# EasyEDA Pro project 效果器12-18.eprj, schematic Schematic1 (continued)
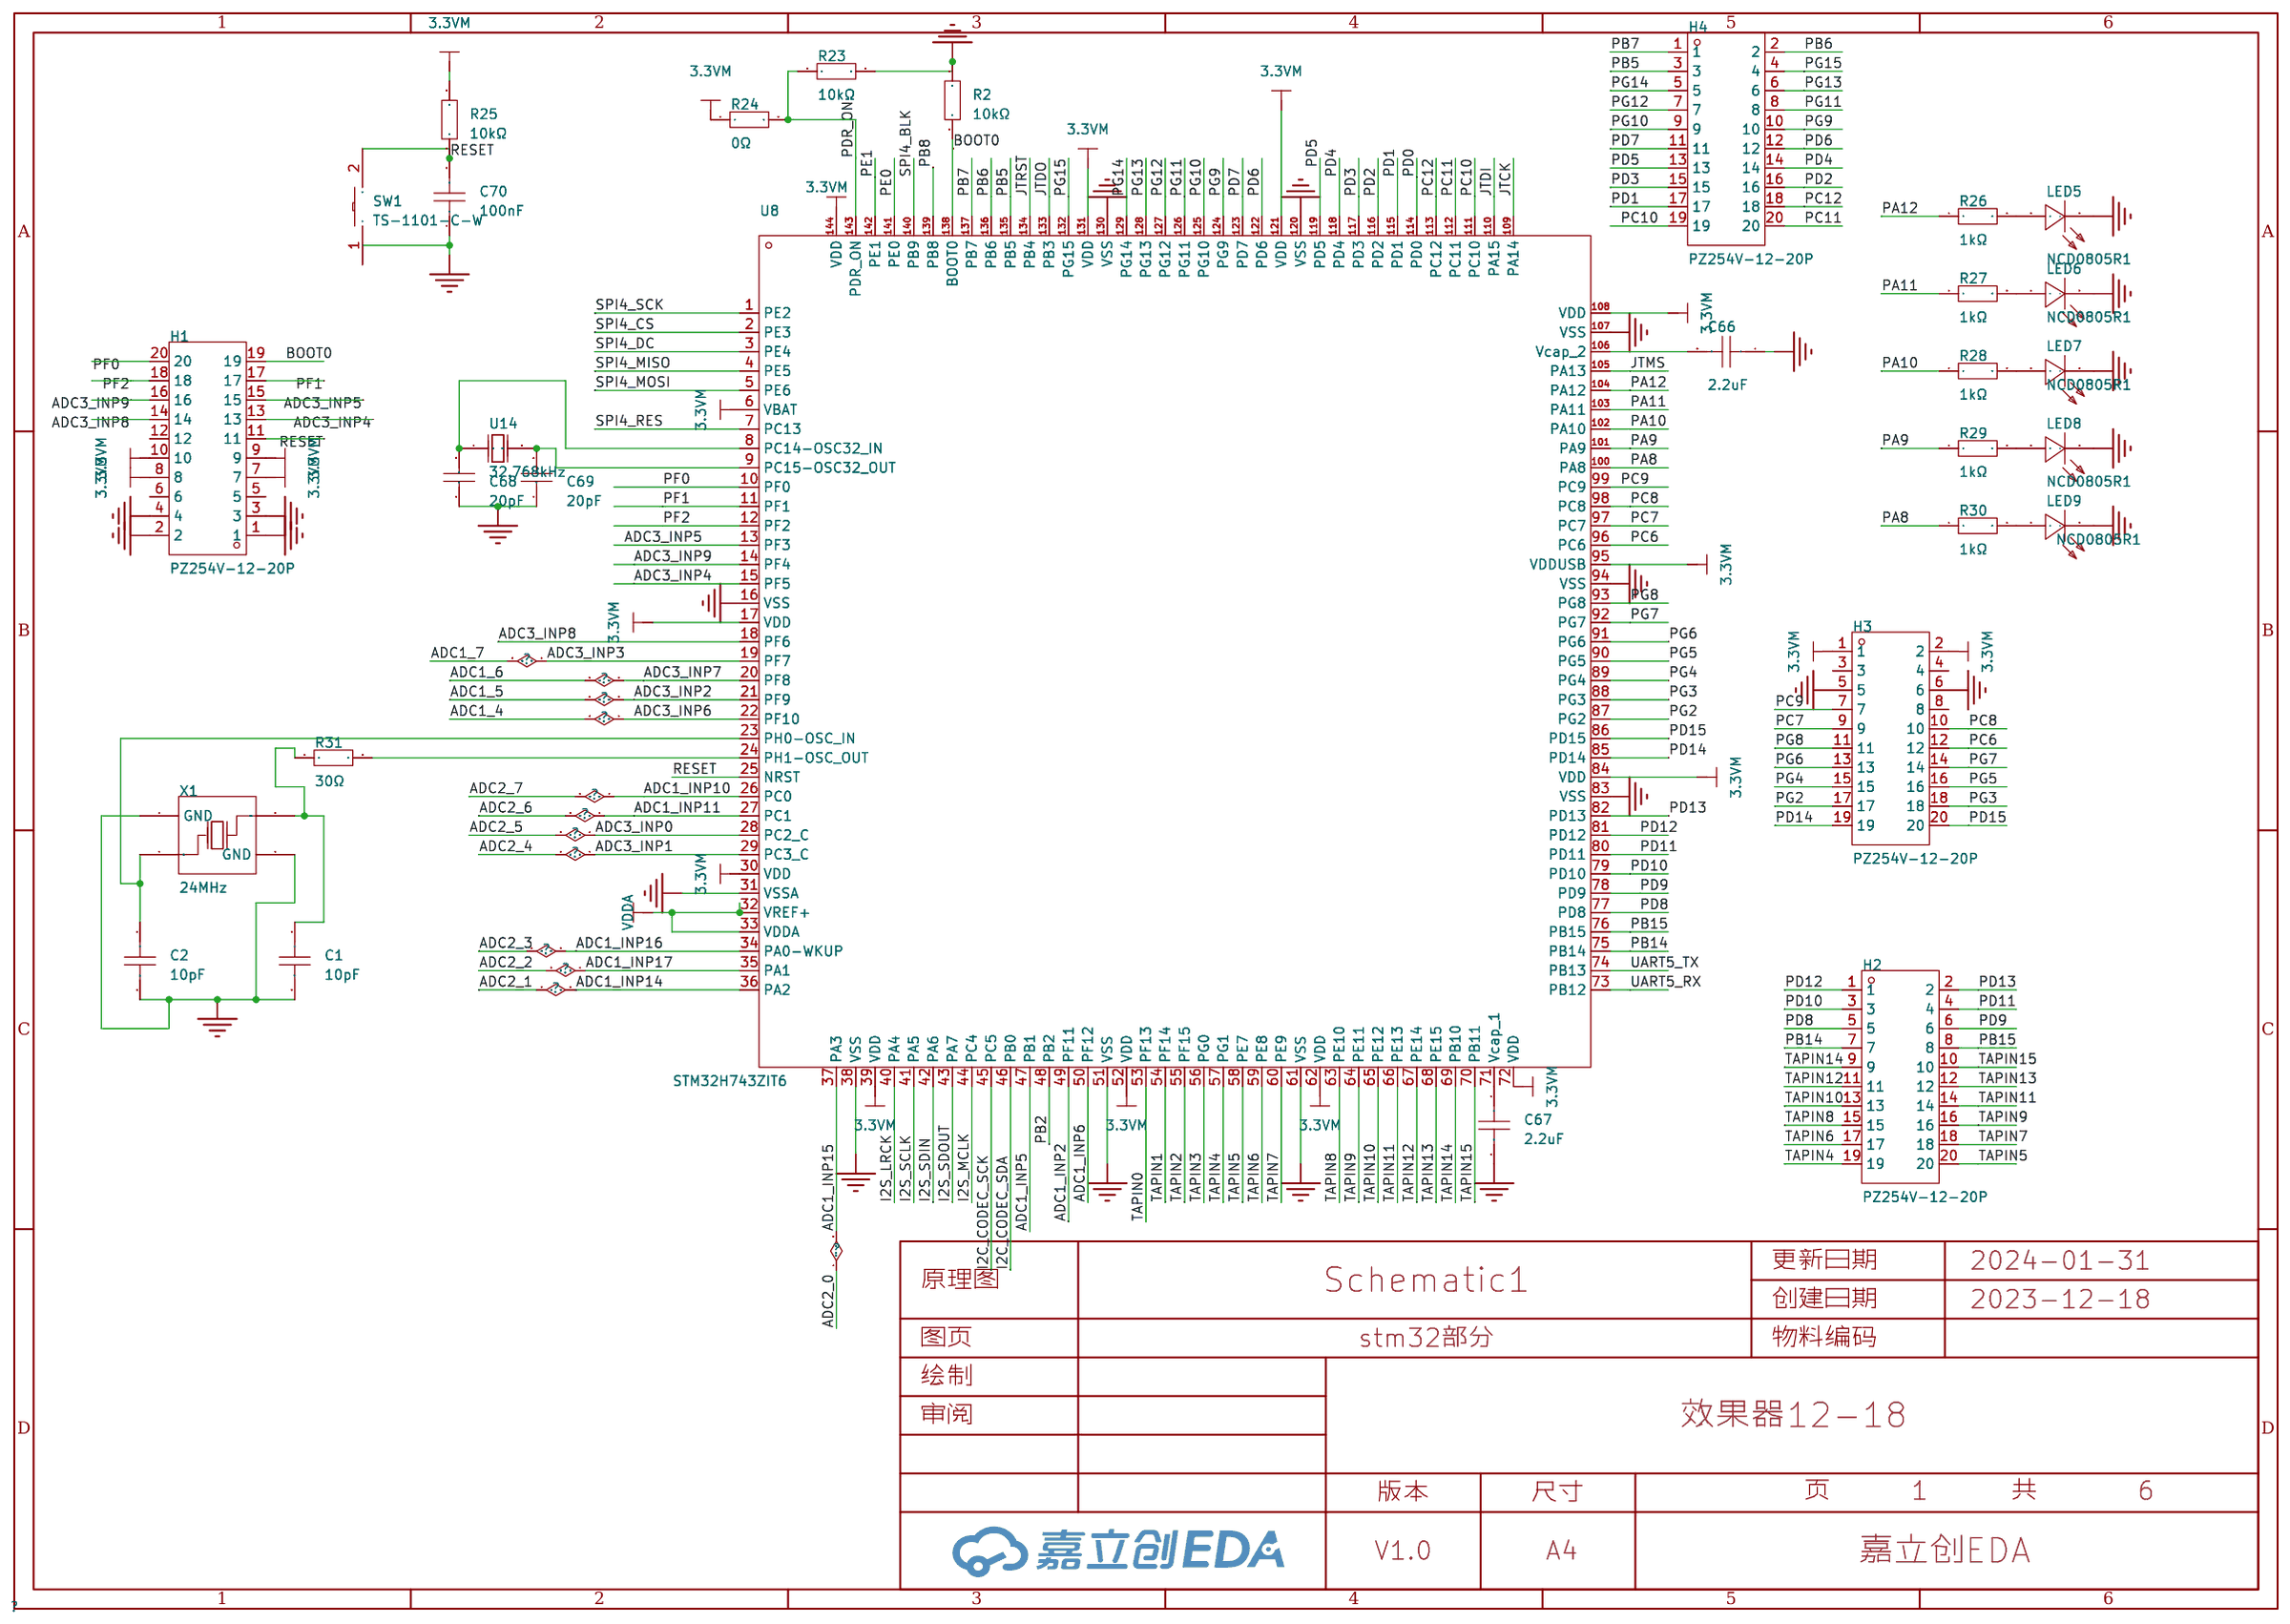
[diagram p0: stm32部分]
## Library data of the parts (continued)
LED5-LED9 = NCD0805R1: 发光颜色:红色;二极管配置:-;功率:65mW;透镜颜色:无色透明;主波长:615nm~630nm;色温:-;发光强度:67mcd~195mcd;发光角度:130°;安装方式:-;工作温度:-30℃~+85℃;; LCSC Part Name: 红灯 0805红灯   正贴; Supplier Part: C84256; Manufacturer: 国星光电; Supplier Footprint: 0805; JLCPCB Part Class: Basic Part; Datasheet: https://atta.szlcsc.com/upload/public/pdf/source/20200820/C84256_F0A75A43B3EAD75808600A0514C76B99.pdf; Supplier: LCSC; Emitted Color: 红色; Forward Voltage (VF): 1.6V~2.6V; Forward Current: 20mA; Power Dissipation: 65mW; Lens Color: 无色透明; Dominant Wavelength: 615nm~630nm; Luminous Intensity: 67mcd~195mcd; Viewing Angle: 130°; Operating Temperature: -30℃~+85℃; Check: true
R2 R8 R10-R14 R23 R25 R33 = 0603WAF1002T5E: 阻值:10kΩ;精度:±1%;功率:100mW;温度系数:±100ppm/℃;电阻类型:厚膜电阻;; LCSC Part Name: 10kΩ ±1% 100mW 厚膜电阻; Supplier Part: C25804; Manufacturer: UNI-ROYAL(厚声); Supplier Footprint: 0603; JLCPCB Part Class: Basic Part; Datasheet: https://atta.szlcsc.com/upload/public/pdf/source/20200306/C422600_1E6D84923E4A46A82E41ADD87F860B5C.pdf; Supplier: LCSC; Tolerance: ±1%; Power(Watts): 100mW; Overload Voltage (Max): 75V; Temperature Coefficient: ±100ppm/℃; Type: 厚膜电阻; Operating Temperature Range: -55℃~+155℃; Check: true
R6 R24 = 0805W8F0000T5E: 阻值:0Ω;精度:±1%;功率:125mW;温度系数:±800ppm/℃;电阻类型:厚膜电阻;; LCSC Part Name: 0Ω ±1% 125mW 厚膜电阻; Supplier Part: C17477; Manufacturer: UNI-ROYAL(厚声); Supplier Footprint: 0805; JLCPCB Part Class: 基础库; Datasheet: https://atta.szlcsc.com/upload/public/pdf/source/20200306/C422600_1E6D84923E4A46A82E41ADD87F860B5C.pdf; Supplier: LCSC; Tolerance: ±1%; Power(Watts): 125mW; Overload Voltage (Max): 150V; Temperature Coefficient: ±800ppm/℃; Type: 厚膜电阻; Operating Temperature Range: -55℃~+155℃; Check: true
R26-R30 R32 R34 R35 = 0603WAF1001T5E: 阻值:1kΩ;精度:±1%;功率:100mW;温度系数:±100ppm/℃;电阻类型:厚膜电阻;; LCSC Part Name: 1kΩ ±1% 100mW 厚膜电阻; Supplier Part: C21190; Manufacturer: UNI-ROYAL(厚声); Supplier Footprint: 0603; JLCPCB Part Class: Basic Part; Datasheet: https://atta.szlcsc.com/upload/public/pdf/source/20200306/C422600_1E6D84923E4A46A82E41ADD87F860B5C.pdf; Supplier: LCSC; Tolerance: ±1%; Power(Watts): 100mW; Overload Voltage (Max): 75V; Temperature Coefficient: ±100ppm/℃; Type: 厚膜电阻; Operating Temperature Range: -55℃~+155℃; Check: true
R31 = RC0402FR-0730RL: 电阻类型:厚膜电阻;阻值:30Ω;精度:±1%;功率:62.5mW;; LCSC Part Name: 30Ω ±1% 62.5mW; Supplier Part: C138007; Manufacturer: YAGEO(国巨); Supplier Footprint: 0402; JLCPCB Part Class: Extended Part; Datasheet: https://atta.szlcsc.com/upload/public/pdf/source/20171107/C138007_15100516349381096934.pdf; Supplier: LCSC; Type: 厚膜电阻; Tolerance: ±1%; Power(Watts): 62.5mW; Temperature Coefficient: ±100ppm/℃; Overload Voltage (Max): 50V; Operating Temperature Range: -55℃~+155℃; Check: true
SW1 = TS-1101-C-W: 电路结构:单刀单掷;带支架:否;触点电流:50mA;额定电压(AC):-;额定电压(DC):12V;额定功率:-;安装方式:立贴;绝缘电阻:-;带灯:无;作用力:260gf;机械寿命:5万次;; LCSC Part Name: 6*3.6*2.5mm 立贴 轻触开关 白色带淡绿按键 卷装; Supplier Part: C318938; Manufacturer: XKB Connectivity(中国星坤); Supplier Footprint: SMD; JLCPCB Part Class: 扩展库; Datasheet: https://atta.szlcsc.com/upload/public/pdf/source/20200227/C318938_C2E53B1EEDE37D980A33616AC086DE53.pdf; Supplier: LCSC; Circuit: 单刀单掷; Actuator Style: 矩形按钮; Switch Length: 6mm; Switch Width: 3.6mm; Switch Height: 2.5mm; Strike Gundam: 否; Contact Current: 50mA; Voltage Rating (DC): 12V; Mounting Style: 立贴; Actuator/Cap Color: 白色带淡绿; With Lamp: 无; Operating Force: 260gf; Mechanical Life: 5万次; Operating Temperature: -30℃~+85℃; Check: true
U8 = STM32H743ZIT6: CPU内核:ARM-M系列;CPU最大主频:480MHz;程序存储容量:2MB;程序存储器类型:FLASH;RAM总容量:1MB;GPIO端口数量:114;; LCSC Part Name: ARM-M系列 480MHz; Supplier Part: C114408; Manufacturer: ST(意法半导体); Supplier Footprint: LQFP-144(20x20); JLCPCB Part Class: 扩展库; Datasheet: https://atta.szlcsc.com/upload/public/pdf/source/20171116/C114408_15108221021511123673.pdf; Supplier: LCSC; CPU Core: ARM-M系列; CPU Maximum Speed: 480MHz; Operating Voltage Range: 1.62V~3.6V; Program Storage Size: 2MB; Program Memory Type: FLASH; RAM Size: 1MB; GPIO Ports Number: 114; ADC (Bit): 16bit; DAC (Bit): 12bit; Universal Serial Bus: 有; Peripheral/Function: DMA；LCD/LED驱动; Watchdog: 有; Infrared Data Association: 有; Low-Voltage Detect: 有; LCD Module: 有; Secure Digital Input and Output: 有; Direct Memory Access: 有; Internal Oscillator: 有; Operating Temperature Range: -40℃~+85℃; Check: true
U14 = RN32768B40: 频率:32.768kHz;负载电容:12.5pF;频率公差:±20ppm;; LCSC Part Name: 32.768kHz ±20ppm 12.5pF; Supplier Part: C7206318; Manufacturer: TROQ(创捷); Supplier Footprint: TuningFork2012; Datasheet: https://atta.szlcsc.com/upload/public/pdf/source/20230606/1A6BC7ABFCE214E301EFD0E0D97E50F7.pdf; Supplier: LCSC; Load Capacitance: 12.5pF; Equivalent Series Resistance (ESR): 70Ω; Frequency Tolerance: ±20ppm; Operating Temperature: -40℃~+85℃; Check: true
X1 = X1E000021012700: 频率:24MHz;负载电容:9pF;频率公差:±10ppm;; LCSC Part Name: 24MHz ±10ppm 9pF; Supplier Part: C89577; Manufacturer: EPSON(爱普生); Supplier Footprint: SMD3225-4P; JLCPCB Part Class: Extended Part; Datasheet: https://atta.szlcsc.com/upload/public/pdf/source/20161130/1480474612820.pdf; Supplier: LCSC; Crystal Type: 贴片无源晶振; Load Capacitance: 9pF; Equivalent Series Resistance (ESR): 40Ω; Frequency Tolerance: ±10ppm; Operating Temperature: -40℃~+85℃; Check: true
D4 = 1N4148WS_C2128: 二极管配置:独立式;正向压降(Vf):1.25V@150mA;直流反向耐压(Vr):100V;平均整流电流(Io):150mA;功率:200mW;反向恢复时间(trr):4ns;; LCSC Part Name: 电压:100V 电流:150mA; Supplier Part: C2128; Manufacturer: CJ(江苏长电/长晶); Supplier Footprint: SOD-323; JLCPCB Part Class: 基础库; Datasheet: https://atta.szlcsc.com/upload/public/pdf/source/20140809/1457707208178.pdf; Supplier: LCSC; Diode Configuration: 独立式; Forward Voltage (Vf@If): 1.25V@150mA; Reverse Voltage (Vr): 100V; Average Rectified Current (Io): 150mA; Power Dissipation: 200mW; Reverse Leakage Current: 1uA@75V; Reverse Recovery Time (trr): 4ns
JTAG1 = BH254V-20P: 连接器类型:简牛座;每排PIN数:10;结构:2x10P;排数:2;间距:2.54mm;行距:2.54mm;封装形式:直插;额定电流:3A;额定电压:250V;工作温度范围:-40℃~+105℃;; LCSC Part Name: 每排P数:10 2x10P 排数:2 2.54mm; Supplier Part: C492444; Manufacturer: XFCN(兴飞); Supplier Footprint: 插件,P=2.54mm; JLCPCB Part Class: Extended Part; Datasheet: https://atta.szlcsc.com/upload/public/pdf/source/20200312/C492444_4AABE2FC4F6BE8226B85135616AF0092.pdf; Supplier: LCSC; Connector Type: 简牛座; Pin Number in each Row: 10; Structure: 2x10P; Number of Rows: 2; Pitch: 2.54mm; Row Spacing: 2.54mm; Holder Type: 直插; Current Rating (Max): 3A; Voltage Rating (Max): 250V; Operating Temperature Range: -40℃~+105℃; Check: true
Q1 = S8050_C2891804: 晶体管类型:NPN;集电极电流(Ic):500mA;集射极击穿电压(Vceo):25V;功率(Pd):300mW;; LCSC Part Name: NPN 电流:500mA 耐压:25V; Supplier Part: C2891804; Manufacturer: YONGYUTAI(永裕泰); Supplier Footprint: SOT-23; JLCPCB Part Class: 扩展库; Datasheet: https://atta.szlcsc.com/upload/public/pdf/source/20210901/5347316A10609C628D4D69AE01446E5B.pdf; Supplier: LCSC; Transistor Type: NPN; Collector Current (Ic): 500mA; Collector-Emitter Breakdown Voltage (Vceo): 25V; Power Dissipation (Pd): 300mW; Collector Cut-Off Current (Icbo): 1uA; Collector-Emitter Saturation Voltage (VCE(sat)@Ic,Ib): 500mV@500mA,50mA
Q2 = S8550_C727136: 晶体管类型:PNP;集电极电流(Ic):500mA;集射极击穿电压(Vceo):25V;功率(Pd):300mW;直流电流增益(hFE@Ic,Vce):200@50mA,1V;; LCSC Part Name: PNP 电流:500mA 耐压:25V; Supplier Part: C727136; Manufacturer: TWGMC(台湾迪嘉); Supplier Footprint: SOT-23; JLCPCB Part Class: 扩展库; Datasheet: https://atta.szlcsc.com/upload/public/pdf/source/20200827/C727136_B498F8FD567BF05363CA70C4EF1CFE98.pdf; Supplier: LCSC; Transistor Type: PNP; Collector Current (Ic): 500mA; Collector-Emitter Breakdown Voltage (Vceo): 25V; Power Dissipation (Pd): 300mW; DC Current Gain (hFE@Ic,Vce): 200@50mA,1V; Transition Frequency (fT): 150MHz; Collector Cut-Off Current (Icbo): 100nA; Collector-Emitter Saturation Voltage (VCE(sat)@Ic,Ib): 600mV@500mA,50mA
SPI_SCREEN = XH-8A: 插针结构:1x8P;间距:2.5mm;安装方式:直插;行距:-;总PIN数:8P;排数:1;每排PIN数:8;参考系列:XH;额定电流:3A;工作温度范围:-25℃~+85℃;; LCSC Part Name: 1x8P 间距:2.5mm 直插 系列:XH; Supplier Part: C2908606; Manufacturer: HCTL(华灿天禄); Supplier Footprint: 插件,P=2.5mm; JLCPCB Part Class: Extended Part; Datasheet: https://atta.szlcsc.com/upload/public/pdf/source/20230711/68D365716984B4AFE576D1D73D61B465.pdf; Supplier: LCSC; Pins Structure: 1x8P; Pitch: 2.5mm; Mounting Style: 直插; Number of Pins: 8P; Number of Rows: 1; Number of PINs Per Row: 8; Reference Series: XH; Current Rating (Max): 3A; Operating Temperature Range: -25℃~+85℃; Check: true
U20 = CH340C: 应用功能:收发器;接口协议:USB 2.0;数据速率:2Mbps;; LCSC Part Name: CH340C USB转串口芯片 CH340; Supplier Part: C84681; Manufacturer: WCH(南京沁恒); Supplier Footprint: SOP-16; JLCPCB Part Class: 扩展库; Datasheet: https://atta.szlcsc.com/upload/public/pdf/source/20200819/C84681_ADBED554CE321879DBD6B1D06488689C.pdf; Supplier: LCSC; Applications Function: 收发器; Protocol: USB 2.0; Data Rate: 2Mbps; Supply Voltage: 3.3V；5V
USB1 = UX-144S-ACP5: 连接器类型:Mini-B;标准:USB 2.0;公母:母;触点数量:5P;端口数量:1;安装方式:卧贴;额定电流 - 电源:1.5A;工作温度范围:-20℃~+70℃;焊接温度(最大值):260℃;; LCSC Part Name: Mini-B 母 卧贴; Supplier Part: C720611; Manufacturer: XUNPU(讯普); Supplier Footprint: SMD; JLCPCB Part Class: Extended Part; Datasheet: https://atta.szlcsc.com/upload/public/pdf/source/20200812/C720611_E8490E4C4B00597353DD684194E98629.pdf; Supplier: LCSC; Connector Type: Mini-B; Standard: USB 2.0; Gender: 母; Number of Contacts: 5P; Number of Ports: 1; Mounting Style: 卧贴; Current Rating - Power (Max): 1.5A; Operating Temperature Range: -20℃~+70℃; Welding Temperature (Max): 260℃; Check: true
C3 = CL10B104KB8NNNC: 容值:100nF;精度:±10%;额定电压:50V;材质(温度系数):X7R;; LCSC Part Name: 100nF ±10% 50V; Supplier Part: C1591; Manufacturer: SAMSUNG(三星); Supplier Footprint: 0603; JLCPCB Part Class: Extended Part; Datasheet: https://atta.szlcsc.com/upload/public/pdf/source/20160218/1457707763339.pdf; Supplier: LCSC; Tolerance: ±10%; Voltage Rated: 50V; Temperature Coefficient: X7R; Check: true
C4 = CL21A106KAYNNNE_C15850: 容值:10uF;精度:±10%;额定电压:25V;材质(温度系数):X5R;; LCSC Part Name: 10uF ±10% 25V; Supplier Part: C15850; Manufacturer: SAMSUNG(三星); Manufacturer Part: CL21A106KAYNNNE; Supplier Footprint: 0805; JLCPCB Part Class: Basic Part; Datasheet: https://atta.szlcsc.com/upload/public/pdf/source/20160103/1457707679302.pdf; Supplier: LCSC; Tolerance: ±10%; Voltage Rated: 25V; Temperature Coefficient: X5R; Power(Watts): 100mW; Overload Voltage (Max): 75V; Type: 厚膜电阻; Operating Temperature Range: -55℃~+155℃; Check: true
C5 = 0805B103K500NT_C52278: 容值:10nF;精度:±10%;额定电压:50V;材质(温度系数):X7R;; LCSC Part Name: 10nF ±10% 50V; Supplier Part: C52278; Manufacturer: FH(风华); Manufacturer Part: 0805B103K500NT; Supplier Footprint: 0805; JLCPCB Part Class: 扩展库; Datasheet: https://atta.szlcsc.com/upload/public/pdf/source/20200305/C486355_26A10D38EF8C2A5C37091D0039909270.pdf; Supplier: LCSC; Tolerance: ±10%; Voltage Rated: 50V; Temperature Coefficient: X7R; Check: true
C7 C10 C13 C31 C32 C48 = RST100UF16V003: 容值:100uF;精度:±20%;额定电压:16V;纹波电流:60mA@120Hz;等效串联电阻:-;; LCSC Part Name: 100uF ±20% 16V; Supplier Part: C4747963; Manufacturer: KNSCHA(科尼盛); Supplier Footprint: SMD,D6.3xL5.4mm; JLCPCB Part Class: Extended Part; Datasheet: https://atta.szlcsc.com/upload/public/pdf/source/20220722/9429C795432790648606E5D5964068FF.pdf; Supplier: LCSC; Tolerance: ±20%; Rated Voltage: 16V; Ripple Current: 60mA@120Hz; φD: 6.3mm; L: 5.4mm; Lifetime @ Temp: 2000hrs@105℃; Operating Temperature: -55℃~+105℃; Check: true
D1-D3 = SS24_C50645: 正向压降(Vf):550mV@2A;直流反向耐压(Vr):40V;平均整流电流(Io):2A;; LCSC Part Name: 电压:40V 电流:2A; Supplier Part: C50645; Manufacturer: MDD; Supplier Footprint: SMA(DO-214AC); JLCPCB Part Class: Extended Part; Datasheet: https://atta.szlcsc.com/upload/public/pdf/source/20230314/0DB686FE9AB7A29C3C9F91DCAAB84FDC.pdf; Supplier: LCSC; Forward Voltage (Vf@If): 550mV@2A; Reverse Voltage (Vr): 40V; Average Rectified Current (Io): 2A; Check: true
DC1 = DC-005-A250: 连接器类型:DC电源插座;安装方式:弯插;触点内径:2.5mm;触点外径:6.3mm;额定电流:3A;额定电压:30V;工作温度范围:-20℃~+70℃;; LCSC Part Name: DC电源插座 内径:2.5mm 外径:6.3mm; Supplier Part: C720558; Manufacturer: XUNPU(讯普); Supplier Footprint: 插件; JLCPCB Part Class: Extended Part; Datasheet: https://atta.szlcsc.com/upload/public/pdf/source/20220428/F133011953B124341225656709BD6AA6.pdf; Supplier: LCSC; Connector Type: DC电源插座; Mounting Style: 弯插; Inside Contact Diameter: 2.5mm; Outside Contact Diameter: 6.3mm; Current Rating (Max): 3A; Voltage Rating (Max): 30V; Operating Temperature Range: -20℃~+70℃; Check: true
F1 F2 = BSMD1206-100-16V: 最大电压:16V;最大电流:100A;保持电流:1A;跳闸电流:1.8A;; LCSC Part Name: 16V 1A 1206自恢复; Supplier Part: C883131; Manufacturer: BHFUSE(佰宏); Supplier Footprint: 1206; JLCPCB Part Class: Extended Part; Datasheet: https://atta.szlcsc.com/upload/public/pdf/source/20230512/E419278EC8529AAF514173EF221BCF4B.pdf; Supplier: LCSC; Operating Voltage (Max): 16V; Current Rating (Max): 100A; Hold Current: 1A; Trip Current: 1.8A; Power Dissipation: 800mW; Resistance - Initial (Ri) (Min): 50mΩ; Resistance - Post Trip (R1) (Max): 270mΩ; Maximum Time to Trip: 300ms; Operating Temperature: -40℃~+85℃; Check: true
L1 = SM3521-4R7MT: 电感值:4.7uH;精度:±20%;额定电流:1A;饱和电流(Isat):1.6A;; LCSC Part Name: 4.7uH ±20% 1.6A; Supplier Part: C35602; Manufacturer: SXN(顺翔诺); Supplier Footprint: SMD; JLCPCB Part Class: Extended Part; Datasheet: https://atta.szlcsc.com/upload/public/pdf/source/20210810/DE909F839CF261ABDAA312DFDF4FA1A6.pdf; Supplier: LCSC; Tolerance: ±20%; Rated Current: 1A; Saturation Current (Isat): 1.6A; DC Resistance (DCR): 135mΩ; Check: true
L2 = PZ1608D121-2R0TF: 标称阻抗@测试频率:120Ω@100MHz;误差:±25%;直流电阻(RDC):-;; LCSC Part Name: 单路 0603磁珠 阻抗120Ω@100MHz; Supplier Part: C42102; Manufacturer: Sunlord(顺络); Supplier Footprint: 0603; JLCPCB Part Class: Extended Part; Datasheet: https://atta.szlcsc.com/upload/public/pdf/source/20210816/2FE48A83668C9496AD98DE44B7F0FA96.pdf; Supplier: LCSC; Impedance @ Frequency: 120Ω@100MHz; Tolerance: ±25%; Current Rating: 2A; Circuits: 1; Check: true
LED1-LED4 = TJ-S1005SW4TGLC9Y-A5: 发光颜色:黄灯;; LCSC Part Name: 黄灯; Supplier Part: C273600; Manufacturer: TOGIALED(统佳); Supplier Footprint: 0402; JLCPCB Part Class: 扩展库; Datasheet: https://atta.szlcsc.com/upload/public/pdf/source/20180904/C273600_90EE9CCDA7679C2DC32A5FA503DEF3E6.pdf; Supplier: LCSC; Emitted Color: 黄灯; Check: true
R3 R5 = CR0805F12K1P05Z: 电阻类型:厚膜电阻;阻值:12.1kΩ;精度:±1%;功率:125mW;; LCSC Part Name: 12.1kΩ ±1% 125mW; Supplier Part: C245232; Manufacturer: EVER OHMS(天二科技); Supplier Footprint: 0805; JLCPCB Part Class: Extended Part; Datasheet: https://atta.szlcsc.com/upload/public/pdf/source/20190516/C245232_35C0C5B85EEB2B9019CCEC90E854E655.pdf; Supplier: LCSC; Type: 厚膜电阻; Tolerance: ±1%; Power(Watts): 125mW; Temperature Coefficient: ±100ppm/℃; Overload Voltage (Max): 150V; Operating Temperature Range: -55℃~+155℃; Check: true
R4 = 0805W8F6802T5E: 阻值:68kΩ;精度:±1%;功率:125mW;温度系数:±100ppm/℃;电阻类型:厚膜电阻;; LCSC Part Name: 68kΩ ±1% 125mW 厚膜电阻; Supplier Part: C17801; Manufacturer: UNI-ROYAL(厚声); Supplier Footprint: 0805; JLCPCB Part Class: Basic Part; Datasheet: https://atta.szlcsc.com/upload/public/pdf/source/20200306/C422600_1E6D84923E4A46A82E41ADD87F860B5C.pdf; Supplier: LCSC; Tolerance: ±1%; Power(Watts): 125mW; Overload Voltage (Max): 150V; Temperature Coefficient: ±100ppm/℃; Type: 厚膜电阻; Operating Temperature Range: -55℃~+155℃; Check: true
U2 = TPMP2359DJ: Supplier Part: C2959845; Manufacturer: TECH PUBLIC(台舟); Supplier Footprint: SOT-23-6; JLCPCB Part Class: 扩展库; Datasheet: https://atta.szlcsc.com/upload/public/pdf/source/20220124/136D7E5097025173C84A8EB547201C3F.pdf; Supplier: LCSC; Check: true
U3 U5 U11 = LM1117S-3.3: 输出类型:固定;输出极性:正;最大输入电压:12V;输出电压:3.3V;输出电流:1A;电源纹波抑制比(PSRR):75dB@(120Hz);; LCSC Part Name: 输入12V 输出3.3V 1A; Supplier Part: C126027; Manufacturer: HTC; Supplier Footprint: SOT-223; JLCPCB Part Class: 扩展库; Datasheet: https://atta.szlcsc.com/upload/public/pdf/source/20170814/C126027_1502678373551885899.pdf; Supplier: LCSC; Output Type: 固定; Output Polarity: 正; Number of Outputs: 1; Maximum Input Voltage: 12V; Output Voltage: 3.3V; Dropout Voltage: 1.3V@(1A); Output Current: 1A; Power Supply Rejection Ratio (PSRR): 75dB@(120Hz); Check: true
C28 C30 C33 C35 = CL10A106MP8NNNC: 容值:10uF;精度:±20%;额定电压:10V;材质(温度系数):X5R;; LCSC Part Name: 10uF ±20% 10V; Supplier Part: C85713; Manufacturer: SAMSUNG(三星); Supplier Footprint: 0603; JLCPCB Part Class: Extended Part; Datasheet: https://atta.szlcsc.com/upload/public/pdf/source/20160218/1457707763339.pdf; Supplier: LCSC; Tolerance: ±20%; Voltage Rated: 10V; Temperature Coefficient: X5R; Check: true
C37 C38 C75 C76 = CL05A105KP5NNNC: 容值:1uF;精度:±10%;额定电压:10V;材质(温度系数):X5R;; LCSC Part Name: 1uF ±10% 10V; Supplier Part: C14445; Manufacturer: SAMSUNG(三星); Supplier Footprint: 0402; JLCPCB Part Class: Extended Part; Datasheet: https://atta.szlcsc.com/upload/public/pdf/source/20160218/1457707763339.pdf; Supplier: LCSC; Tolerance: ±10%; Voltage Rated: 10V; Temperature Coefficient: X5R; Check: true
CN1 = PJ-313D_C668608: 连接器类型:3.5mm耳机座;额定电流:500mA;额定电压:30V;工作温度范围:-30℃~+70℃;; LCSC Part Name: 3.5mm耳机座; Supplier Part: C668608; Manufacturer: SHOU HAN(首韩); Supplier Footprint: SMD; JLCPCB Part Class: Extended Part; Datasheet: https://atta.szlcsc.com/upload/public/pdf/source/20200618/C668608_AB2020DBBA26E8897834D328F2FA3C40.pdf; Supplier: LCSC; Connector Type: 3.5mm耳机座; Current Rating (Max): 500mA; Voltage Rating (Max): 30V; Operating Temperature Range: -30℃~+70℃; Check: true
LINEIN1 LINEOUT1 = ZX-XH2.54-3PZZ: 插针结构:1x3P;间距:2.54mm;安装方式:直插;行距:-;总PIN数:3P;排数:1;每排PIN数:3;参考系列:XH;额定电流:3A;触头材质:黄铜;触头镀层:锡;工作温度范围:-25℃~+85℃;; LCSC Part Name: 1x3P 间距:2.54mm 直插 系列:XH; Supplier Part: C7429633; Manufacturer: Megastar(兆星); Supplier Footprint: 插件,P=2.54mm; JLCPCB Part Class: Extended Part; Datasheet: https://atta.szlcsc.com/upload/public/pdf/source/20230619/AE17037A2CFDBE8D9CBA775D61AD0A84.pdf; Supplier: LCSC; Pins Structure: 1x3P; Pitch: 2.54mm; Mounting Style: 直插; Number of Pins: 3P; Number of Rows: 1; Number of PINs Per Row: 3; Reference Series: XH; Current Rating (Max): 3A; Contact Material: 黄铜; Contact Plating: 锡; Operating Temperature Range: -25℃~+85℃; Pin Structure: 1x3P; Mounting Type: 直插; Circluar Pins/Square Pins: 方针; Voltage Rating (Max): 250V; Length of Mating Pin: 6mm; Insulation Height: 2.5mm; Length of End Connection Pin: 3mm; Color: 黑色; Check: true
R7 = 0603WAF100JT5E: 阻值:10Ω;精度:±1%;功率:100mW;温度系数:±400ppm/℃;电阻类型:厚膜电阻;; LCSC Part Name: 10Ω ±1% 100mW 厚膜电阻; Supplier Part: C22859; Manufacturer: UNI-ROYAL(厚声); Supplier Footprint: 0603; JLCPCB Part Class: Basic Part; Datasheet: https://atta.szlcsc.com/upload/public/pdf/source/20200306/C422600_1E6D84923E4A46A82E41ADD87F860B5C.pdf; Supplier: LCSC; Tolerance: ±1%; Power(Watts): 100mW; Overload Voltage (Max): 75V; Temperature Coefficient: ±400ppm/℃; Type: 厚膜电阻; Operating Temperature Range: -55℃~+155℃; Check: true
R36-R39 = 1206W4F1004T5E: 阻值:1MΩ;精度:±1%;功率:250mW;温度系数:±100ppm/℃;电阻类型:厚膜电阻;; LCSC Part Name: 1MΩ ±1% 250mW 厚膜电阻; Supplier Part: C17927; Manufacturer: UNI-ROYAL(厚声); Supplier Footprint: 1206; JLCPCB Part Class: 基础库; Datasheet: https://atta.szlcsc.com/upload/public/pdf/source/20200306/C422600_1E6D84923E4A46A82E41ADD87F860B5C.pdf; Supplier: LCSC; Tolerance: ±1%; Power(Watts): 250mW; Overload Voltage (Max): 200V; Temperature Coefficient: ±100ppm/℃; Type: 厚膜电阻; Operating Temperature Range: -55℃~+155℃
R41 R42 = RC0603FR-07100RL: 电阻类型:厚膜电阻;阻值:100Ω;精度:±1%;功率:100mW;最大工作电压:75V;温度系数:±100ppm/℃;; LCSC Part Name: 厚膜电阻 100Ω ±1% 100mW; Supplier Part: C105588; Manufacturer: YAGEO(国巨); Supplier Footprint: 0603; JLCPCB Part Class: 扩展库; Datasheet: https://atta.szlcsc.com/upload/public/pdf/source/20180316/70C0E2BDAE7FCC62C531A5A58D202EE1.pdf; Supplier: LCSC; Type: 厚膜电阻; Tolerance: ±1%; Power(Watts): 100mW; Overload Voltage (Max): 75V; Temperature Coefficient: ±100ppm/℃; Operating Temperature Range: -55℃~+155℃
TEST_PIN = PZ127V-11-08-H25: 排数:单排;总PIN位数:8P;间距:1.27mm;插针结构:1x8P;行距:-;安装类型:直插;圆针/方针:方针;额定电流:1A;额定电压:-;配合针长度:2.9mm;塑高:2.5mm;端接针长度:2mm;触头材质:-;工作温度范围:-40℃~+105℃;颜色:黑色;; LCSC Part Name: 1.27mm 1x8P 直插 方针; Supplier Part: C2832275; Manufacturer: XFCN(兴飞); Supplier Footprint: 插件,P=1.27mm; JLCPCB Part Class: Extended Part; Datasheet: https://atta.szlcsc.com/upload/public/pdf/source/20210514/C2832275_BD749B30D866C52F97BC12DF1CF0E812.pdf; Supplier: LCSC; Number of Rows: 单排; Number of Pins: 8P; Pitch: 1.27mm; Pin Structure: 1x8P; Mounting Type: 直插; Circluar Pins/Square Pins: 方针; Current Rating (Max): 1A; Length of Mating Pin: 2.9mm; Insulation Height: 2.5mm; Length of End Connection Pin: 2mm; Operating Temperature Range: -40℃~+105℃; Color: 黑色; Check: true
U6 = WM8978CGEFL/RV: Supplier Part: C323850; Manufacturer: Cirrus Logic(凌云); Supplier Footprint: QFN-32-EP(5x5); JLCPCB Part Class: 扩展库; Datasheet: https://atta.szlcsc.com/upload/public/pdf/source/20181105/C323850_5F65153DE4172B7DF9579D926852F69A.pdf; Supplier: LCSC; Check: true
U21-U24 = SMTSO3050CTJ: M3x5.56xL5+1.53; LCSC Part Name: 雄和远景，电路板表贴圆螺母柱，M3X5，铜镀锡,1个; Supplier Part: C2915636; Manufacturer: Sinhoo(雄和远景); JLCPCB Part Class: Extended Part; Datasheet: https://atta.szlcsc.com/upload/public/pdf/source/20211122/17CF5E24EB4D4DC090A80DE3D7DE5E21.pdf; Supplier: LCSC

## Nets
3.3V: C9.2 C10.1 C14.2 C15.2 C16.2 C17.2 C18.2 C19.2 C20.2 C21.2 C22.2 C23.2 C24.2 C25.2 C71.2 C72.2 C74.2 H1.7 H1.8 H1.9 H1.10 H3.1 H3.2 JTAG1.1 JTAG1.2 L2.1 Q2.2(E) R7.1 R10.2 R11.2 R12.2 R14.2 R20.2 R24.1 R25.2 R33.1 SPI_SCREEN.2 U3.2(OUT) U3.4(TAB) U8.6(VBAT) U8.17(VDD) U8.30(VDD) U8.39(VDD) U8.52(VDD) U8.62(VDD) U8.72(VDD) U8.84(VDD) U8.95(VDDUSB) U8.108(VDD) U8.121(VDD) U8.131(VDD) U8.144(VDD) U20.4(V3) U20.16(VCC)
3.3V_NOB: AD1_INF0.3 AD1_INF1.3 AD1_INF2.3 AD1_INF3.3 AD1_INF4.3 AD1_INF5.3 AD1_INF6.3 AD1_INF7.3 AD2_INF0.3 AD2_INF1.3 AD2_INF2.3 AD2_INF3.3 AD2_INF4.3 AD2_INF5.3 AD2_INF6.3 AD2_INF7.3 C47.2 C48.1 R21.2 U11.2(OUT) U11.4(TAB)
3.3VA: C12.2 C13.1 C33.2 C34.2 R19.2 U5.2(OUT) U5.4(TAB) U6.31(AVDD)
+5V: C8.2 C11.2 C28.2 C29.2 C46.2 F2.1 R22.2 U3.3(IN) U5.3(IN) U6.26(SPKVDD) U11.3(IN)
+12V: D1.2(A) F1.2
AGND: C30.1 R6.1 U6.28(AGND2)
GND: AD1_INF0.1 AD1_INF1.1 AD1_INF2.1 AD1_INF3.1 AD1_INF4.1 AD1_INF5.1 AD1_INF6.1 AD1_INF7.1 AD2_INF0.1 AD2_INF1.1 AD2_INF2.1 AD2_INF3.1 AD2_INF4.1 AD2_INF5.1 AD2_INF6.1 AD2_INF7.1 C1.2 C2.2 C3.1 C4.1 C6.1 C7.2 C8.1 C9.1 C10.2 C11.1 C12.1 C13.2 C14.1 C15.1 C16.1 C17.1 C18.1 C19.1 C20.1 C21.1 C22.1 C23.1 C24.1 C25.1 C26.1 C27.1 C28.1 C29.1 C33.1 C34.1 C35.1 C36.1 C46.1 C47.1 C48.2 C50.2 C51.2 C52.2 C53.2 C54.2 C55.2 C56.2 C57.2 C58.2 C59.2 C60.2 C61.2 C62.2 C63.2 C64.2 C65.2 C66.1 C67.2 C68.1 C69.1 C70.1 C71.1 C72.1 C74.1 CN1.1 D2.2(A) DC1.2 H1.1 H1.2 H1.3 H1.4 H3.5 H3.6 JTAG1.4 JTAG1.6 JTAG1.8 JTAG1.10 JTAG1.12 JTAG1.14 JTAG1.16 JTAG1.18 JTAG1.20 LED1.1(C) LED2.1(C) LED3.1(C) LED4.1(C) LED5.2(-) LED6.2(-) LED7.2(-) LED8.2(-) LED9.2(-) LINEIN1.2 LINEOUT1.2 R2.1 R5.1 R6.2 R8.1 R13.2 R15.1 R16.1 R17.1 R18.1 R23.2 R36.1 R37.1 R38.2 R39.1 SPI_SCREEN.1 SW1.1 U2.2(GND) U3.1(ADJ/GND) U5.1(ADJ/GND) U6.2(LIN) U6.5(RIN) U6.12(DGND) U6.24(SPKGND) U6.33(PAD) U8.16(VSS) U8.31(VSSA) U8.38(VSS) U8.51(VSS) U8.61(VSS) U8.83(VSS) U8.94(VSS) U8.107(VSS) U8.120(VSS) U8.130(VSS) U11.1(ADJ/GND) U20.1(GND) U21.1 U22.1 U23.1 U24.1 USB1.4(ID) USB1.5(GND) USB1.6(GND) USB1.7(GND) USB1.8(GND) USB1.9(GND) X1.2(GND) X1.4(GND)
VDDA: C26.2 C27.2 L2.2 U8.32(VREF+) U8.33(VDDA)
+12: C3.2 C4.2 D1.1(K) R3.1 U2.5(IN)
ADC1_4: AD1_INF4.2 C59.1 U8.22(PF10)
ADC1_5: AD1_INF5.2 C60.1 U8.21(PF9)
ADC1_6: AD1_INF6.2 C61.1 U8.20(PF8)
ADC1_7: AD1_INF7.2 C62.1 U8.19(PF7)
ADC1_INP2: U8.49(PF11)
ADC1_INP5: U8.47(PB1)
ADC1_INP6: U8.50(PF12)
ADC1_INP10: AD2_INF7.2 C57.1 U8.26(PC0)
ADC1_INP11: AD2_INF6.2 C56.1 U8.27(PC1)
ADC1_INP14: AD2_INF1.2 C51.1 U8.36(PA2)
ADC1_INP15: AD2_INF0.2 C50.1 U8.37(PA3)
ADC1_INP16: AD2_INF3.2 C53.1 U8.34(PA0-WKUP)
ADC1_INP17: AD2_INF2.2 C52.1 U8.35(PA1)
ADC2_4: AD2_INF4.2 C54.1 U8.29(PC3_C)
ADC2_5: AD2_INF5.2 C55.1 U8.28(PC2_C)
ADC3_INP4: H1.13 U8.15(PF5)
ADC3_INP5: H1.15 U8.13(PF3)
ADC3_INP8: H1.14 U8.18(PF6)
ADC3_INP9: H1.16 U8.14(PF4)
BOOT0: H1.19 R2.2 R35.2 U8.138(BOOT0)
DCIN: DC1.1 F1.1
I2C_CODEC_SCK: TEST_PIN.6 U6.16(SCLK) U8.45(PC5)
I2C_CODEC_SDA: TEST_PIN.7 U6.17(SDIN) U8.46(PB0)
I2S_LRCK: TEST_PIN.1 U6.7(LRC) U8.40(PA4)
I2S_MCLK: TEST_PIN.5 U6.11(MCLK) U8.44(PC4)
I2S_SCLK: TEST_PIN.2 U6.8(BCLK) U8.41(PA5)
I2S_SDIN: TEST_PIN.3 U6.9(ADCDAT) U8.42(PA6)
I2S_SDOUT: TEST_PIN.4 U6.10(DACDAT) U8.43(PA7)
JTCK: JTAG1.9 R13.1 U8.109(PA14)
JTDI: JTAG1.5 R11.1 U8.110(PA15)
JTDO: JTAG1.13 R14.1 U8.133(PB3)
JTMS: JTAG1.7 R12.1 U8.105(PA13)
JTRST: JTAG1.3 R10.1 U8.134(PB4)
PA8: R30.1 U8.100(PA8)
PA9: R29.1 U8.101(PA9)
PA10: R28.1 U8.102(PA10)
PA11: R27.1 U8.103(PA11)
PA12: R26.1 U8.104(PA12)
PB2: U8.48(PB2)
PB5: H4.3 U8.135(PB5)
PB6: H4.2 U8.136(PB6)
PB7: H4.1 U8.137(PB7)
PB8: U8.139(PB8)
PB14: H2.7 U8.75(PB14)
PB15: H2.8 U8.76(PB15)
PC6: H3.12 U8.96(PC6)
PC7: H3.9 U8.97(PC7)
PC8: H3.10 U8.98(PC8)
PC9: H3.7 U8.99(PC9)
PC10: H4.19 U8.111(PC10)
PC11: H4.20 U8.112(PC11)
PC12: H4.18 U8.113(PC12)
PD0: U8.114(PD0)
PD1: H4.17 U8.115(PD1)
PD2: H4.16 U8.116(PD2)
PD3: H4.15 U8.117(PD3)
PD4: H4.14 U8.118(PD4)
PD5: H4.13 U8.119(PD5)
PD6: H4.12 U8.122(PD6)
PD7: H4.11 U8.123(PD7)
PD8: H2.5 U8.77(PD8)
PD9: H2.6 U8.78(PD9)
PD10: H2.3 U8.79(PD10)
PD11: H2.4 U8.80(PD11)
PD12: H2.1 U8.81(PD12)
PD13: H2.2 U8.82(PD13)
PD14: H3.19 U8.85(PD14)
PD15: H3.20 U8.86(PD15)
PDR_ON: R23.1 R24.2 U8.143(PDR_ON)
PE0: U8.141(PE0)
PE1: U8.142(PE1)
PF0: H1.20 U8.10(PF0)
PF1: H1.17 U8.11(PF1)
PF2: H1.18 U8.12(PF2)
PG2: H3.17 U8.87(PG2)
PG3: H3.18 U8.88(PG3)
PG4: H3.15 U8.89(PG4)
PG5: H3.16 U8.90(PG5)
PG6: H3.13 U8.91(PG6)
PG7: H3.14 U8.92(PG7)
PG8: H3.11 U8.93(PG8)
PG9: H4.10 U8.124(PG9)
PG10: H4.9 U8.125(PG10)
PG11: H4.8 U8.126(PG11)
PG12: H4.7 U8.127(PG12)
PG13: H4.6 U8.128(PG13)
PG14: H4.5 U8.129(PG14)
PG15: H4.4 U8.132(PG15)
RESET: C70.2 D4.2(A) H1.11 JTAG1.15 R25.1 SW1.2 U8.25(NRST)
SPI4_BLK: SPI_SCREEN.8 U8.140(PB9)
SPI4_CS: SPI_SCREEN.7 U8.2(PE3)
SPI4_DC: SPI_SCREEN.6 U8.3(PE4)
SPI4_MISO: U8.4(PE5)
SPI4_MOSI: SPI_SCREEN.4 U8.5(PE6)
SPI4_RES: SPI_SCREEN.5 U8.7(PC13)
SPI4_SCK: SPI_SCREEN.3 U8.1(PE2)
TAPIN0: AD1_INF1.2 C63.1 R16.2 U8.53(PF13)
TAPIN1: AD1_INF2.2 C64.1 R17.2 U8.54(PF14)
TAPIN2: AD1_INF0.2 C58.1 R15.2 U8.55(PF15)
TAPIN3: AD1_INF3.2 C65.1 R18.2 U8.56(PG0)
TAPIN4: H2.19 U8.57(PG1)
TAPIN5: H2.20 U8.58(PE7)
TAPIN6: H2.17 U8.59(PE8)
TAPIN7: H2.18 U8.60(PE9)
TAPIN8: H2.15 U8.63(PE10)
TAPIN9: H2.16 U8.64(PE11)
TAPIN10: H2.13 U8.65(PE12)
TAPIN11: H2.14 U8.66(PE13)
TAPIN12: H2.11 U8.67(PE14)
TAPIN13: H2.12 U8.68(PE15)
TAPIN14: H2.9 U8.69(PB10)
TAPIN15: H2.10 U8.70(PB11)
UART5_RX: U8.73(PB12) U20.2(TXD)
UART5_TX: U8.74(PB13) U20.3(RXD)
VUSB: D3.1(K) F2.2 USB1.1(VBUS)
$1N724: C1.1 R31.1 X1.3(OSC2)
$1N734: R31.2 U8.24(PH1-OSC_OUT)
$1N753: C2.1 U8.23(PH0-OSC_IN) X1.1(OSC1)
$1N2566: C66.2 U8.106(Vcap_2)
$1N2628: C67.1 U8.71(Vcap_1)
$1N3081: C68.2 U8.8(PC14-OSC32_IN) U14.1(OSC1)
$1N3094: C69.2 U8.9(PC15-OSC32_OUT) U14.2(OSC2)
$1N5110: LED5.1(+) R26.2
$1N5149: LED6.1(+) R27.2
$1N5188: LED7.1(+) R28.2
$1N5227: LED8.1(+) R29.2
$1N5266: LED9.1(+) R30.2
$2N626: C30.2 U6.27(VMID)
$2N922: C31.1 U6.30(LOUT1)
$2N925: C31.2 CN1.3
$2N935: C32.2 CN1.2
$2N949: C32.1 U6.29(ROUT1)
$2N1307: C35.2 C36.2 R7.2 U6.13(DCVDD) U6.14(DBVDD)
$2N1631: C38.1 R39.2 U6.3(L2/GPIO2)
$2N1634: C38.2 LINEIN1.3
$2N1638: C37.1 R38.1 U6.6(R2/GPIO3)
$2N1641: C37.2 LINEIN1.1
$2N1734: R8.2 U6.18(MODE)
$2N11598: C75.2 U6.21(OUT4)
$2N11640: C76.2 U6.22(OUT3)
$2N12068: LINEOUT1.3 R36.2 R41.1
$2N12069: C75.1 R41.2
$2N12112: LINEOUT1.1 R37.2 R42.2
$2N12113: C76.1 R42.1
$4N793: R3.2 U2.4(EN)
$4N1079: C5.2 U2.1(BS)
$4N1099: C5.1 D2.1(K) L1.1 U2.6(SW)
$4N1267: R4.2 R5.2 U2.3(FB)
$4N1433: C6.2 C7.1 D3.2(A) L1.2 R4.1
$4N4463: LED1.2(A) R19.1
$4N4590: LED2.2(A) R20.1
$4N4676: LED3.2(A) R21.1
$4N4798: LED4.2(A) R22.1
$6N5826: U20.5(D+) USB1.3(D+)
$6N5830: U20.6(D-) USB1.2(D-)
$6N6583: Q1.1(B) R32.1
$6N6635: D4.1(K) Q1.3(C) R33.2
$6N6759: R32.2 U20.13(DTR#)
$6N6810: Q1.2(E) R34.2 U20.14(RTS#)
$6N6816: Q2.1(B) R34.1
$6N6867: Q2.3(C) R35.1

Not connected (* = marked no-connect by the designer): DC1 3; H1 5 6 12; H3 3 4 8; JTAG1 11 17 19; TEST_PIN 8; U6 1(LIP) 4(RIP) 15(CSB/GPIO1) 19(AUXL) 20(AUXR) 23(ROUT2) 25(LOUT2) 32(MICB/AS); U20 7(NC.) 8(OUT#) 9(CTS#) 10(DSR#) 11(RI#) 12(DCD#) 15(R232)
